# EasyEDA Pro project 智能母版V4.eprj, board PCB1 (continued)
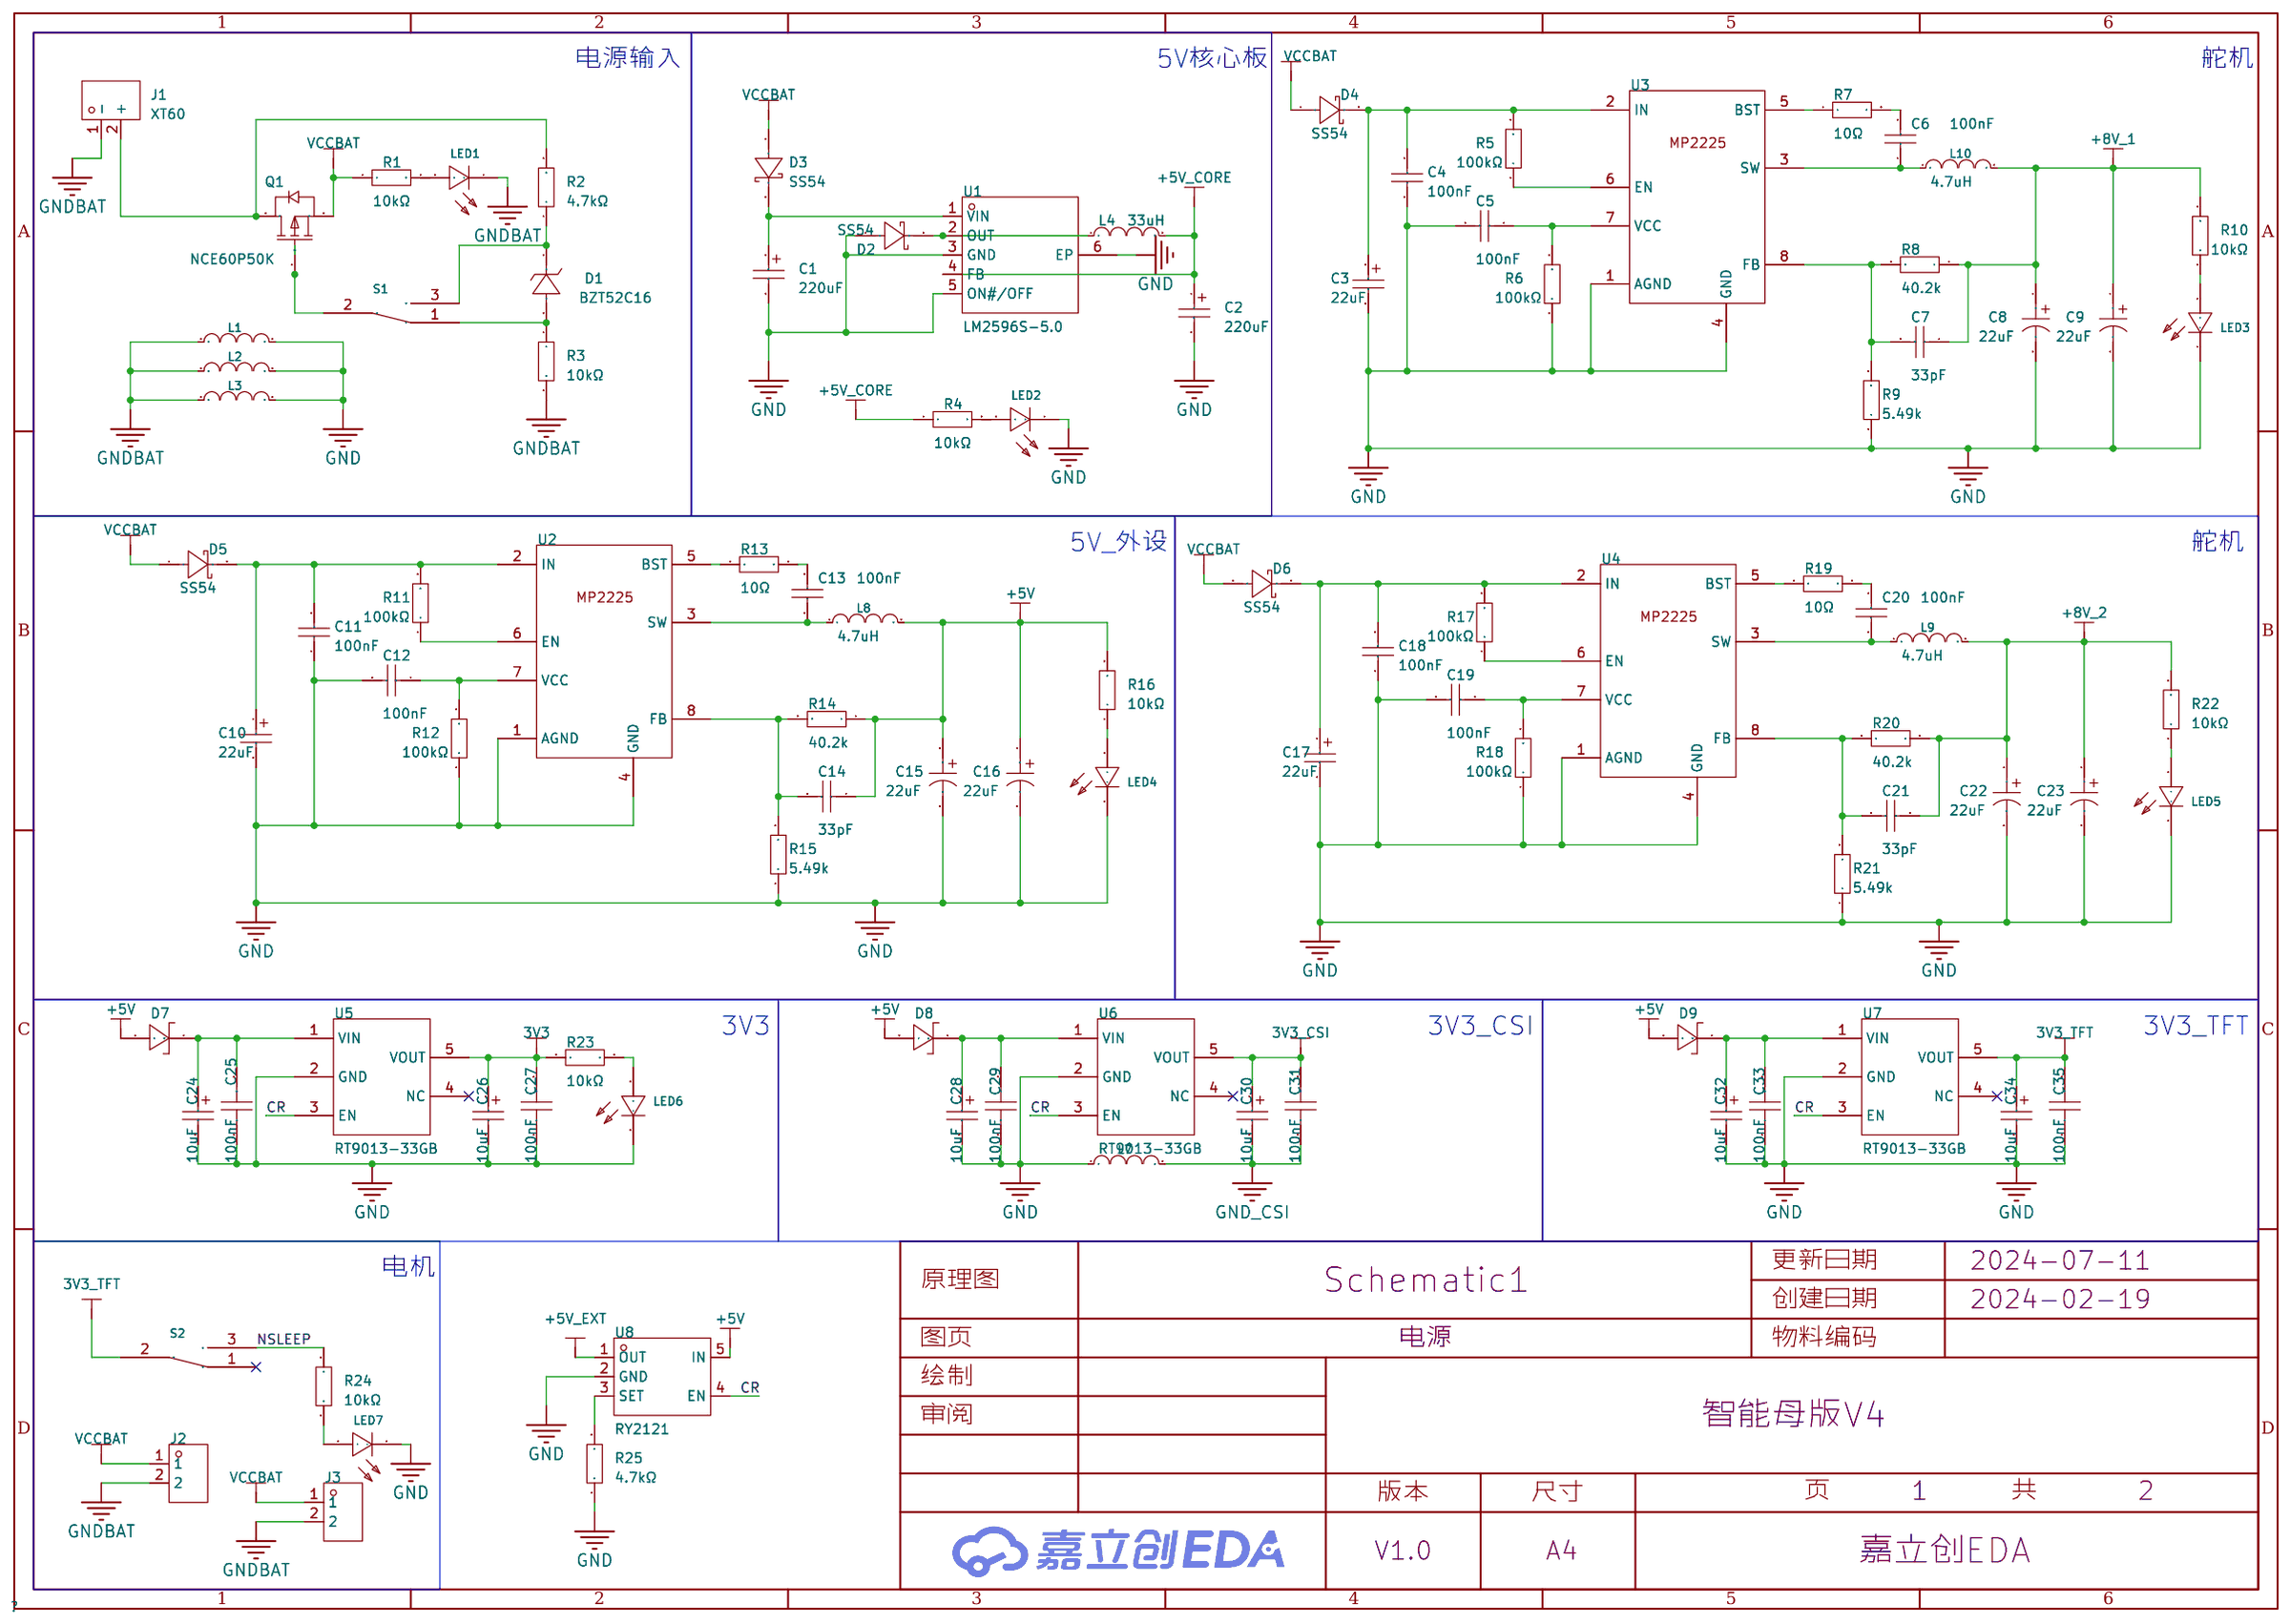
[diagram p0: 电源]
## Copper pours and planes (outline as drawn; the poured copper is in the pictures) (continued)
$1N430 on Top Layer: 16.06,14.14 16.06,17.02 9.53,17.02 9.53,10.31 13.29,10.31 13.29,14.14 13.33,14.14
$1N431 on Top Layer: 8.44,0.27 20.83,0.27 20.83,3.3 20.96,3.43 15.8,3.43 15.8,9.35 8.44,9.35
$1N432 on Bottom Layer: 17.4,5.46 15.11,5.46 15.11,7.75 5.59,7.75 5.59,15.11 9.01,15.11 9.01,10.03 17.4,10.03
$1N22092 on Top Layer: 22.1,69.21 23.28,69.21 23.28,65.95 22.14,65.95 22.1,65.91
$1N25035 on Top Layer: 6.94,66.54 6.94,69.21 14.99,69.21 14.99,64.74 10.62,64.74 10.62,66.54 6.95,66.54
$1N25035 on Bottom Layer: 6.96,66.67 10.26,66.67 10.26,81.03 6.96,81.03
$1N25688 on Top Layer: 26.38,24.69 28.55,24.69 28.55,21.08 26.42,21.08 26.38,21.12
$1N25688 on Top Layer: 22.86,20.94 24.26,20.94 24.26,21.58 28.62,21.58 28.7,18.16 33.15,18.16 33.15,14.99 29.07,14.99 29.07,16.84 25.7,16.84 25.65,16.89 25.65,20.45 23.49,20.45 23.49,18.92 22.86,18.92
$1N25697 on Top Layer: 33.92,16.43 35.43,16.43 35.43,13.14 33.91,13.14 33.91,16.42
$1N25841 on Top Layer: 22.24,10.31 19.42,10.31 19.42,12.92 18.68,12.92 18.68,16.24 18.67,16.26 21.49,16.26 21.49,18.54 22.24,18.54 22.24,20.32 22.82,20.32 22.82,18.54 23.17,18.54 23.17,10.31 22.25,10.31
$1N26496 on Top Layer: 23.93,39.88 23.93,42.16 27.27,42.16 27.27,54.09 29.31,54.09 29.31,41.35 25.93,41.35 25.93,41.66 24.51,41.66 24.51,39.88 24.51,39.88
$1N26528 on Top Layer: 19.63,30.21 19.63,36.7 22.62,36.7 22.62,38.86 23.27,38.86 23.27,41.56 23.88,41.56 23.88,30.21
$1N27190 on Top Layer: 5.46,41.78 5.46,44.09 9.27,44.09 9.27,47.87 13.54,47.87 13.54,44.98 14.2,44.98 14.22,44.96 14.22,42.56 6.12,42.56 6.12,41.81 6.1,41.78
$1N27197 on Top Layer: 15.85,42.94 17.35,42.94 17.35,40.26 15.82,40.26 15.82,42.9
$1N27244 on Top Layer: 4.32,33.01 0.66,33.01 0.66,39.32 4.24,39.32 4.32,39.24 4.32,41.4 4.83,41.4 4.83,43.32 5.48,43.32 5.48,33 4.33,33
$2N16532 on Bottom Layer: 32.8,64.9 35.97,64.9 35.97,74.48 28.32,74.48 28.32,79.67 25.2,79.67 25.2,72.14 32.8,72.14
$2N16600 on Top Layer: 12.84,87.9 14.34,87.9 14.34,85.46 14.22,85.34 14.22,84.95 12.84,84.95 12.84,87.9
$2N16605 on Bottom Layer: 25.27,80.14 28.7,80.14 28.7,83.31 24.21,83.31 24.21,89.22 20.47,89.22 20.47,84.84 15.19,84.84 15.19,83.12 20.57,83.12 20.57,81.79 25.27,81.79 25.27,81.79

Small or netless copper shapes (teardrops, artwork), in the pictures only: 565 on Top Layer, 291 on Bottom Layer, 2 on GND, 43 on PWR

## Text on the board
Top Layer: DEBUG | HZCU | 2024
Top Solder Mask Layer: DEBUG | HZCU | 2024
Top Silkscreen Layer: B12 | B18 | D0 | D2 | D1 | B11 | D3 | C6 | 电磁铁 | 电机 | 蓝牙 | 5V | LF | 测距 | RF | 陀螺仪 | 人机交互 | +5V | +8V | 电源 | CSI | UART2 | UART1 | LB | RB | UART4 | + | ON
